# EAGLE design ECU (EAGLE 6.5.0)
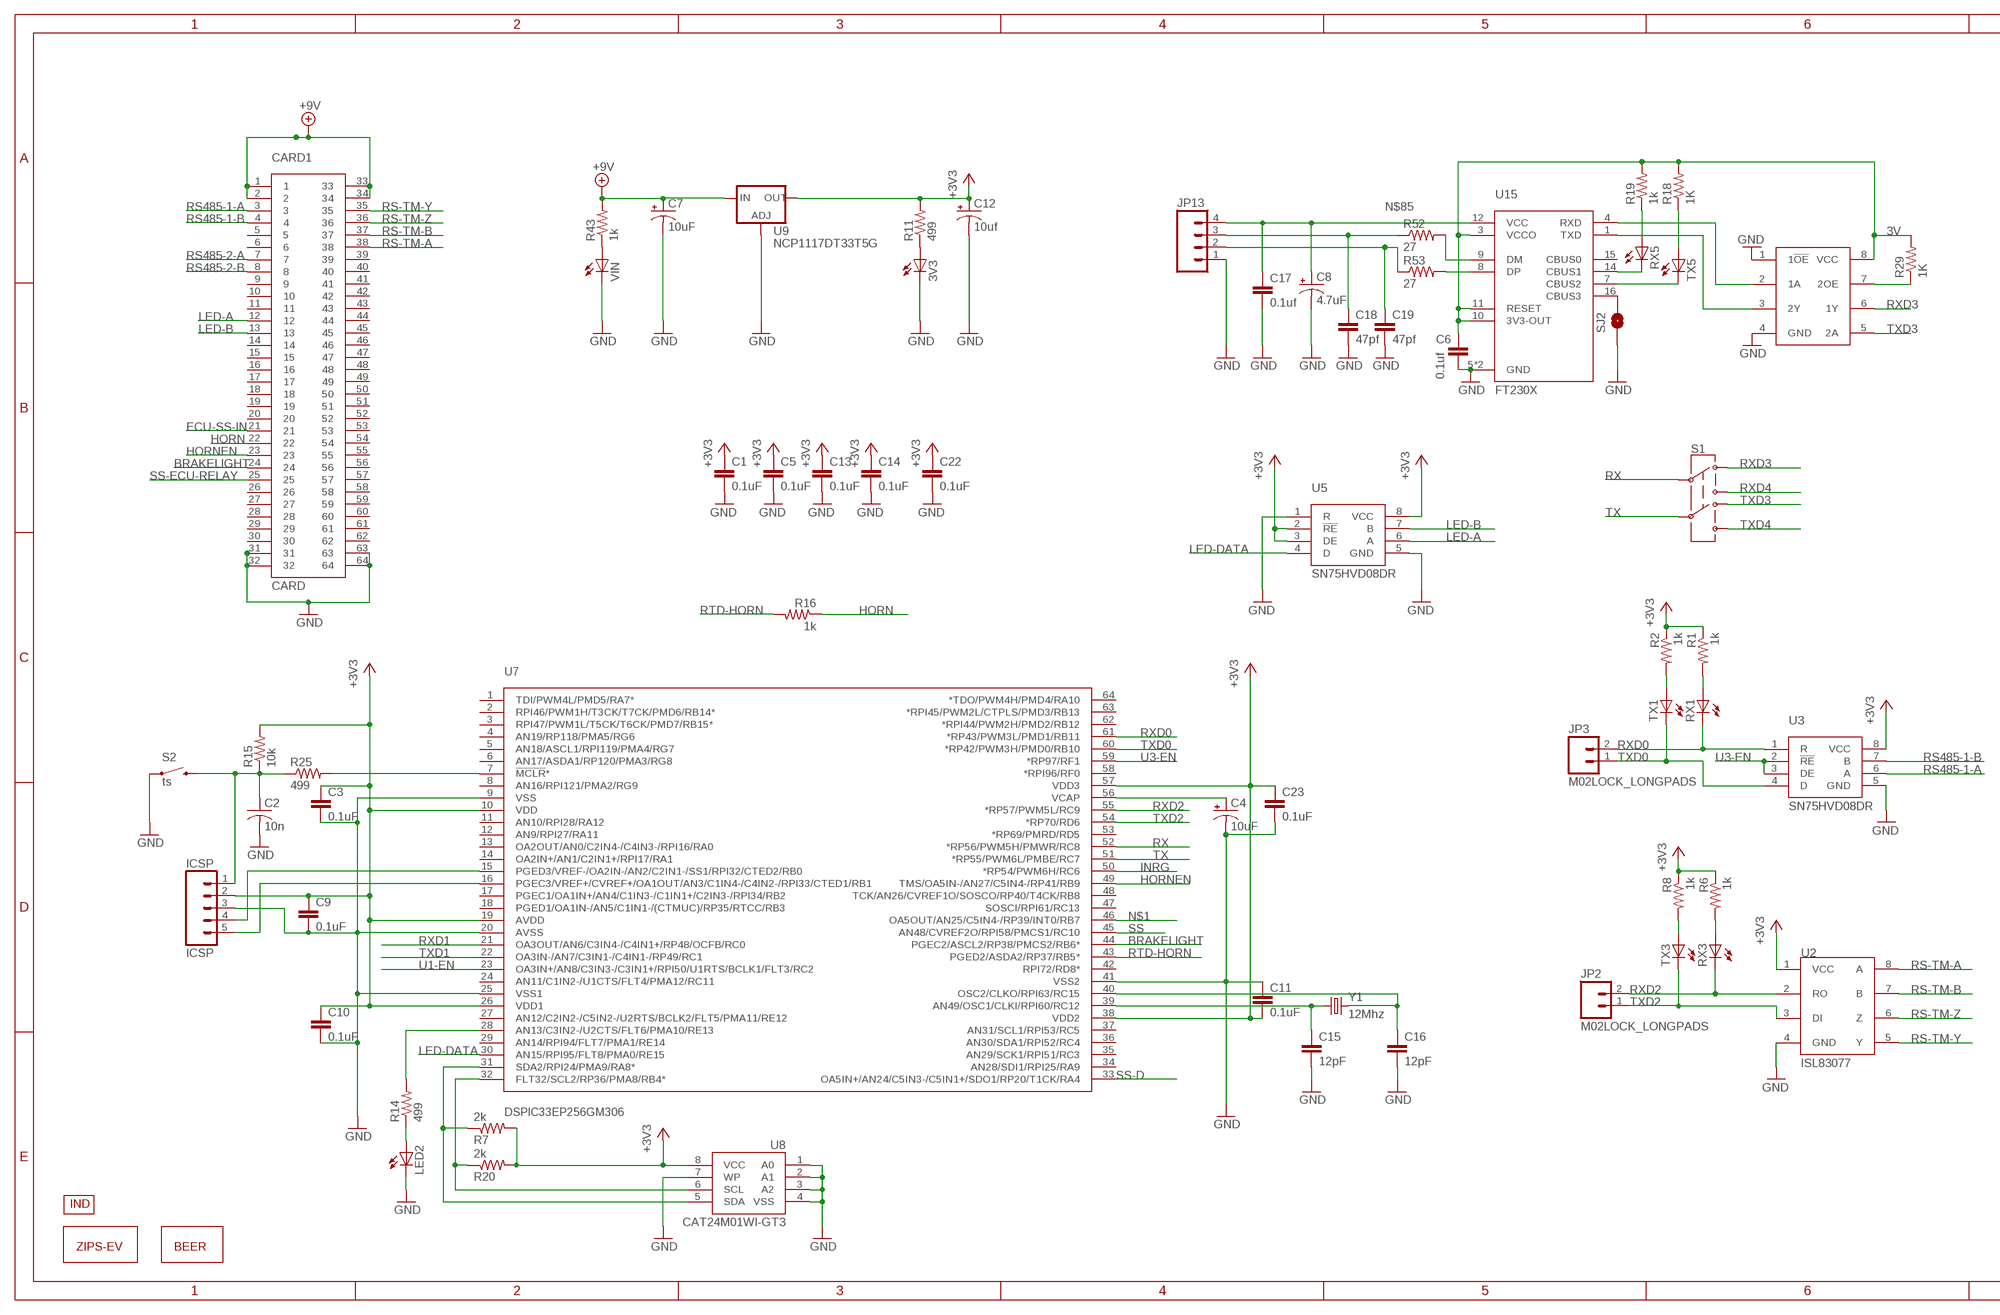
[diagram p0: schematic, sheet 1, part 1 of 2]
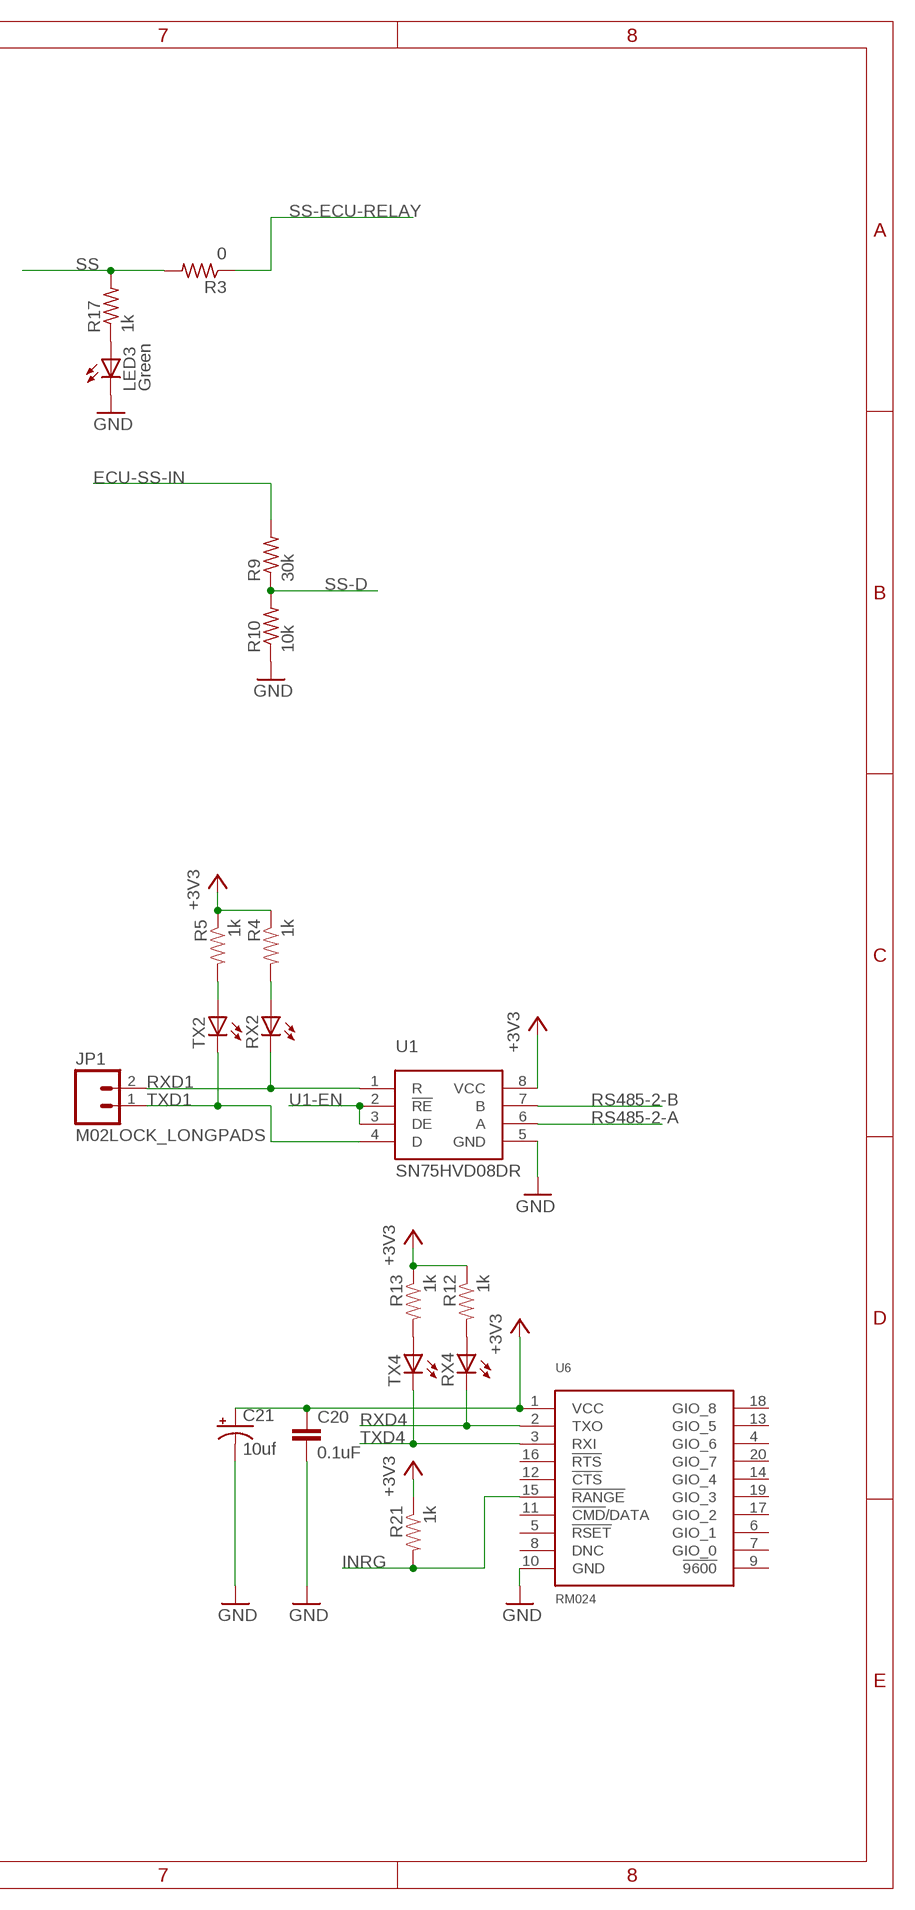
[diagram p1: schematic, sheet 1, part 2 of 2]

## Parts
3V3  LEDCHIP-LED0805  [CHIP-LED0805]
C1  0.1uF  CAP0805  [0805]
C2  10n  C-USC0805  [C0805]
C3  0.1uF  CAP0805  [0805]
C4  10uF  10UF-TANT  [EIA3216]
C5  0.1uF  CAP0805  [0805]
C6  0.1uf  CAP0805  [0805]
C7  10uF  CAP_POL7343  [EIA7343]
C8  4.7uF  CAP_POL1206  [EIA3216]
C9  0.1uF  CAP0805  [0805]
C10  0.1uF  CAP0805  [0805]
C11  0.1uF  CAP0805  [0805]
C12  10uf  CAP_POL3528  [EIA3528]
C13  0.1uF  CAP0805  [0805]
C14  0.1uF  CAP0805  [0805]
C15  12pF  CAP0805  [0805]
C16  12pF  CAP0805  [0805]
C17  0.1uf  CAP0805  [0805]
C18  47pf  CAP0805  [0805]
C19  47pf  CAP0805  [0805]
C20  0.1uF  CAP0805  [0805]
C21  10uf  CAP_POL3528  [EIA3528]
C22  0.1uF  CAP0805  [0805]
C23  0.1uF  CAP0805  [0805]
CARD1  CARD  [CARD-64]
ICSP  ICSP  M05LOCK_LONGPADS  [1X05_LOCK_LONGPADS]
JP1  M02LOCK_LONGPADS  [1X02_LOCK_LONGPADS]
JP2  M02LOCK_LONGPADS  [1X02_LOCK_LONGPADS]
JP3  M02LOCK_LONGPADS  [1X02_LOCK_LONGPADS]
JP13  M04POLAR_LOCK  [MOLEX-1X4_LOCK]
LED2  LEDCHIP-LED0805  [CHIP-LED0805]
LED3  Green  LEDCHIPLED_0805  [CHIPLED_0805]
R1  1k  RESISTOR0805-RES  [0805]
R2  1k  RESISTOR0805-RES  [0805]
R3  0  R-US_R0805  [R0805]
R4  1k  RESISTOR0805-RES  [0805]
R5  1k  RESISTOR0805-RES  [0805]
R6  1k  RESISTOR0805-RES  [0805]
R7  2k  RESISTOR0805-RES  [0805]
R8  1k  RESISTOR0805-RES  [0805]
R9  30k  R-US_R0805  [R0805]
R10  10k  R-US_R0805  [R0805]
R11  499  R-US_R0805  [R0805]
R12  1k  RESISTOR0805-RES  [0805]
R13  1k  RESISTOR0805-RES  [0805]
R14  499  RESISTOR0805-RES  [0805]
R15  10k  RESISTOR0805-RES  [0805]
R16  1k  RESISTOR0805-RES  [0805]
R17  1k  R-US_R0805  [R0805]
R18  1K  R-US_R0805  [R0805]
R19  1k  R-US_R0805  [R0805]
R20  2k  RESISTOR0805-RES  [0805]
R21  1k  RESISTOR0805-RES  [0805]
R25  499  RESISTOR0805-RES  [0805]
R29  1K  R-US_R0805  [R0805]
R43  1k  R-US_R0805  [R0805]
R52  27  RESISTOR0805-RES  [0805]
R53  27  RESISTOR0805-RES  [0805]
RX1  LEDCHIP-LED0805  [CHIP-LED0805]
RX2  LEDCHIP-LED0805  [CHIP-LED0805]
RX3  LEDCHIP-LED0805  [CHIP-LED0805]
RX4  LEDCHIP-LED0805  [CHIP-LED0805]
RX5  LEDCHIPLED_0805  [CHIPLED_0805]
S1  SWITCH-DPDTEG2211  [EG2211]
S2  ts  SWITCH-MOMENTARY-2SIDE_EZ  [TACTILE-PTH-SIDEEZ]
SJ2  JUMPER-PAD-2-NOYES_SILK  [PAD-JUMPER-2-NO_YES_SILK]
TX1  LEDCHIP-LED0805  [CHIP-LED0805]
TX2  LEDCHIP-LED0805  [CHIP-LED0805]
TX3  LEDCHIP-LED0805  [CHIP-LED0805]
TX4  LEDCHIP-LED0805  [CHIP-LED0805]
TX5  LEDCHIPLED_0805  [CHIPLED_0805]
U1  SN75HVD08DR  [SO-8]
U2  ISL83077  [SO08]
U3  SN75HVD08DR  [SO-8]
U4  SN74LVC2G241DCTR  [VFSOP-8]
U5  SN75HVD08DR  [SO-8]
U6  RM024  [RM024-TH]
U7  DSPIC33EP256GM306  [TQFP-64]
U8  CAT24M01WI-GT3  EEPROM-I2CSMD  [SO08]
U9  NCP1117DT33T5G  V_REG_317DPACK  [V-REG_DPACK]
U15  FT230X  [SSOP-16]
U$1  INDPK1  [PICKIT-PIN-1]
U$2  LOGOM  [L-M]
U$3  BEERM  [B-M]
VIN  LEDCHIP-LED0805  [CHIP-LED0805]
Y1  12Mhz  CRYSTAL5X3  [CRYSTAL-SMD-5X3]

## Nets
3V: C6.1 R18.2 R19.2 R29.2 U4.8(VCC) U15.3(VCCO) U15.10(3V3-OUT) U15.11(RESET)
+3V3: C1.1 C3.1 C5.1 C9.1 C10.1 C11.2 C12.A(+) C13.1 C14.1 C20.1 C21.A(+) C22.1 C23.1 ICSP.2 R1.1 R2.1 R4.1 R5.1 R6.1 R7.2 R8.1 R11.2 R12.1 R13.1 R15.2 R20.2 R21.1 U1.8(VCC) U2.1(VCC) U3.8(VCC) U5.2(!RE) U5.3(DE) U5.8(VCC) U6.1(VCC) U7.10(VDD) U7.19(AVDD) U7.26(VDD1) U7.38(VDD2) U7.57(VDD3) U8.8(VCC) U9.4(OUT)
+9V: C7.A(+) CARD1.1 CARD1.2 CARD1.33 CARD1.34 R43.2 U9.3(IN)
BRAKELIGHT: CARD1.24 U7.44(PGEC2/ASCL2/RP38/PMCS2/RB6*)
ECU-SS-IN: CARD1.21 R9.2
GND: 3V3.C C1.2 C2.2 C3.2 C4.C(-) C5.2 C6.2 C7.C(-) C8.C(-) C9.2 C10.2 C11.1 C12.C(-) C13.2 C14.2 C15.2 C16.2 C17.2 C18.2 C19.2 C20.2 C21.C(-) C22.2 C23.2 CARD1.31 CARD1.32 CARD1.63 CARD1.64 ICSP.3 JP13.1 LED2.C LED3.C R10.1 S2.1 SJ2.1 U1.5(GND) U2.4(GND) U3.5(GND) U4.1(1!OE) U4.4(GND) U5.1(R) U5.5(GND) U6.10(GND) U7.9(VSS) U7.20(AVSS) U7.25(VSS1) U7.41(VSS2) U8.1(A0) U8.2(A1) U8.3(A2) U8.4(VSS) U8.7(WP) U9.1(ADJ) U15.5(GND) U15.13(GND) VIN.C
HORN: CARD1.22 R16.1
HORNEN: CARD1.23 U7.49(TMS/OA5IN-/AN27/C5IN4-/RP41/RB9)
INRG: R21.2 U6.15(!RANGE) U7.50(*RP54/PWM6H/RC6)
LED-A: CARD1.12 U5.6(A)
LED-B: CARD1.13 U5.7(B)
LED-DATA: U5.4(D) U7.30(AN15/RPI95/FLT8/PMA0/RE15)
N$1: U7.46(OA5OUT/AN25/C5IN4-/RP39/INT0/RB7)
N$2: R14.2 U7.28(AN13/C3IN2-/U2CTS/FLT6/PMA10/RE13)
N$3: 3V3.A R11.1
N$4: R18.1 TX5.A
N$5: R4.2 RX2.A
N$6: R5.2 TX2.A
N$7: R1.2 RX1.A
N$8: R2.2 TX1.A
N$9: R6.2 RX3.A
N$10: R8.2 TX3.A
N$11: R12.2 RX4.A
N$12: R13.2 TX4.A
N$13: C16.1 U7.40(OSC2/CLKO/RPI63/RC15) Y1.3
N$14: C15.1 U7.39(AN49/OSC1/CLKI/RPI60/RC12) Y1.1
N$15: LED2.A R14.1
N$16: R7.1 U7.31(SDA2/RPI24/PMA9/RA8*) U8.5(SDA)
N$18: R19.1 RX5.A
N$19: TX5.C U15.7(CBUS2)
N$20: RX5.C U15.14(CBUS1)
N$21: U4.2(1A) U15.4(RXD)
N$27: U4.3(2Y) U15.1(TXD)
N$28: R52.2 U15.9(DM)
N$32: R20.1 U7.32(FLT32/SCL2/RP36/PMA8/RB4*) U8.6(SCL)
N$33: R43.1 VIN.A
N$49: LED3.A R17.1
N$54: R53.2 U15.8(DP)
N$55: C18.1 JP13.3 R52.1
N$61: C19.1 JP13.2 R53.1
N$62: SJ2.2 U15.16(CBUS3)
N$69: R29.1 U4.7(2OE)
N$85: C8.A(+) C17.1 JP13.4 U15.12(VCC)
N$86: C2.1 ICSP.1 R15.1 R25.1 S2.2
N$87: R25.2 U7.7(!MCLR!*)
N$88: C4.A(+) U7.56(VCAP)
N$90: ICSP.4 U7.15(PGED3/VREF-/OA2IN-/AN2/C2IN1-/SS1/RPI32/CTED2/RB0)
N$91: ICSP.5 U7.16(PGEC3/VREF+/CVREF+/OA1OUT/AN3/C1IN4-/C4IN2-/RPI33/CTED1/RB1)
RS485-1-A: CARD1.3 U3.6(A)
RS485-1-B: CARD1.4 U3.7(B)
RS485-2-A: CARD1.7 U1.6(A)
RS485-2-B: CARD1.8 U1.7(B)
RS-TM-A: CARD1.38 U2.8(A)
RS-TM-B: CARD1.37 U2.7(B)
RS-TM-Y: CARD1.35 U2.5(Y)
RS-TM-Z: CARD1.36 U2.6(Z)
RTD-HORN: R16.2 U7.43(PGED2/ASDA2/RP37/RB5*)
RX: S1.P1 U7.52(*RP56/PWM5H/PMWR/RC8)
RXD0: JP3.2 RX1.C U3.1(R) U7.61(*RP43/PWM3L/PMD1/RB11)
RXD1: JP1.2 RX2.C U1.1(R) U7.21(OA3OUT/AN6/C3IN4-/C4IN1+/RP48/OCFB/RC0)
RXD2: JP2.2 RX3.C U2.2(RO) U7.55(*RP57/PWM5L/RC9)
RXD3: S1.P1-TA U4.6(1Y)
RXD4: RX4.C S1.P1-TB U6.2(TXO)
SS: R3.2 R17.2 U7.45(AN48/CVREF2O/RPI58/PMCS1/RC10)
SS-D: R9.1 R10.2 U7.33(OA5IN+/AN24/C5IN3-/C5IN1+/SDO1/RP20/T1CK/RA4)
SS-ECU-RELAY: CARD1.25 R3.1
TX: S1.P2 U7.51(*RP55/PWM6L/PMBE/RC7)
TXD0: JP3.1 TX1.C U3.4(D) U7.60(*RP42/PWM3H/PMD0/RB10)
TXD1: JP1.1 TX2.C U1.4(D) U7.22(OA3IN-/AN7/C3IN1-/C4IN1-/RP49/RC1)
TXD2: JP2.1 TX3.C U2.3(DI) U7.54(*RP70/RD6)
TXD3: S1.P2-TA U4.5(2A)
TXD4: S1.P2-TB TX4.C U6.3(RXI)
U1-EN: U1.2(!RE) U1.3(DE) U7.23(OA3IN+/AN8/C3IN3-/C3IN1+/RPI50/U1RTS/BCLK1/FLT3/RC2)
U3-EN: U3.2(!RE) U3.3(DE) U7.59(*RP97/RF1)
Unconnected: CARD1.5 CARD1.6 CARD1.9 CARD1.10 CARD1.11 CARD1.14 CARD1.15 CARD1.16 CARD1.17 CARD1.18 CARD1.19 CARD1.20 CARD1.26 CARD1.27 CARD1.28 CARD1.29 CARD1.30 CARD1.39 CARD1.40 CARD1.41 CARD1.42 CARD1.43 CARD1.44 CARD1.45 CARD1.46 CARD1.47 CARD1.48 CARD1.49 CARD1.50 CARD1.51 CARD1.52 CARD1.53 CARD1.54 CARD1.55 CARD1.56 CARD1.57 CARD1.58 CARD1.59 CARD1.60 CARD1.61 CARD1.62 U6.4(GIO_6) U6.5(!RSET) U6.6(GIO_1) U6.7(GIO_0) U6.8(DNC) U6.9(!9600) U6.11(!CMD!/DATA) U6.12(!CTS) U6.13(GIO_5) U6.14(GIO_4) U6.16(!RTS) U6.17(GIO_2) U6.18(GIO_8) U6.19(GIO_3) U6.20(GIO_7) U7.1(TDI/PWM4L/PMD5/RA7*) U7.2(RPI46/PWM1H/T3CK/T7CK/PMD6/RB14*) U7.3(RPI47/PWM1L/T5CK/T6CK/PMD7/RB15*) U7.4(AN19/RP118/PMA5/RG6) U7.5(AN18/ASCL1/RPI119/PMA4/RG7) U7.6(AN17/ASDA1/RP120/PMA3/RG8) U7.8(AN16/RPI121/PMA2/RG9) U7.11(AN10/RPI28/RA12) U7.12(AN9/RPI27/RA11) U7.13(OA2OUT/AN0/C2IN4-/C4IN3-/RPI16/RA0) U7.14(OA2IN+/AN1/C2IN1+/RPI17/RA1) U7.17(PGEC1/OA1IN+/AN4/C1IN3-/C1IN1+/C2IN3-/RPI34/RB2) U7.18(PGED1/OA1IN-/AN5/C1IN1-/(CTMUC)/RP35/RTCC/RB3) U7.24(AN11/C1IN2-/U1CTS/FLT4/PMA12/RC11) U7.27(AN12/C2IN2-/C5IN2-/U2RTS/BCLK2/FLT5/PMA11/RE12) U7.29(AN14/RPI94/FLT7/PMA1/RE14) U7.34(AN28/SDI1/RPI25/RA9) U7.35(AN29/SCK1/RPI51/RC3) U7.36(AN30/SDA1/RPI52/RC4) U7.37(AN31/SCL1/RPI53/RC5) U7.42(RPI72/RD8*) U7.47(SOSCI/RPI61/RC13) U7.48(TCK/AN26/CVREF1O/SOSCO/RP40/T4CK/RB8) U7.53(*RP69/PMRD/RD5) U7.58(*RPI96/RF0) U7.62(*RPI44/PWM2H/PMD2/RB12) U7.63(*RPI45/PWM2L/CTPLS/PMD3/RB13) U7.64(*TDO/PWM4H/PMD4/RA10) U15.15(CBUS0)

## Library data of the parts
3V3 LED2 LED3 RX1-RX5 TX1-TX5 VIN = adafruit:LED: LED OSRAM: - CHIPLED LG R971, LG N971, LY N971, LG Q971, LY Q971, LO R971, LY R971 LH N974, LH R974 LS Q976, LO Q976, LY Q976 LO Q996 - Hyper CHIPLED LW Q18S LB Q993, LB Q99A, LB R99A - SideLED LS A670, LO A670, LY A670, LG A670, LP A670 LB A673, LV A673, LT A673, LW A673 LH A674 LY A675 LS A676, LA A676, LO A676, LY A676, LW A676 LS A679, LY A679, LG A679 - Hyper Micro SIDELED® LS Y876, LA Y876, LO Y876, LY Y876 LT Y87S - SmartLED LW L88C, LW L88S LB L89C, LB L89S, LG L890 LS L89K, LO L89K, LY L89K LS L896, LA L896, LO L896, LY L896 - TOPLED LS T670, LO T670, LY T670, LG T670, LP T670 LSG T670, LSP T670, LSY T670, LOP T670, LYG T670 LG T671, LOG T671, LSG T671 LB T673, LV T673, LT T673, LW T673 LH T674 LS T676, LA T676, LO T676, LY T676, LB T676, LH T676, LSB T676, LW T676 LB T67C, LV T67C, LT T67C, LS T67K, LO T67K, LY T67K, LW E67C LS E67B, LA E67B, LO E67B, LY E67B, LB E67C, LV E67C, LT E67C LW T67C LS T679, LY T679, LG T679 LS T770, LO T770, LY T770, LG T770, LP T770 LB T773, LV T773, LT T773, LW T773 LH T774 LS E675, LA E675, LY E675, LS T675 LS T776, LA T776, LO T776, LY T776, LB T776 LHGB T686 LT T68C, LB T68C - Hyper Mini TOPLED® LB M676 - Mini TOPLED Santana® LG M470 LS M47K, LO M47K, LY M47K Source: http://www.osram.convergy.de/
C1 C3 C5 C9-C11 C13-C16 C20 C22 C23 = SparkFun-Capacitors:CAP: Capacitor Standard 0603 ceramic capacitor, and 0.1" leaded capacitor.
C2 = adafruit:C-US: CAPACITOR, American symbol
C4 = SparkFun-Capacitors:10UF-TANT: 10uF Tantalum SMT CAP-00811- 16V 10% (EIA-3216); PROD_ID: CAP-00811
C6 C17-C19 = SparkFun:CAP: Capacitor Standard 0603 ceramic capacitor, and 0.1" leaded capacitor.
C7 C12 C21 = SparkFun-Capacitors:CAP_POL: Capacitor Polarized These are standard SMD and PTH capacitors. Normally 10uF, 47uF, and 100uF in electrolytic and tantalum varieties. Always verify the external diameter of the through hole cap, it varies with capacity, voltage, and manufacturer. The EIA devices should be standard.
C8 = SparkFun:CAP_POL: Capacitor Polarized These are standard SMD and PTH capacitors. Normally 10uF, 47uF, and 100uF in electrolytic and tantalum varieties. Always verify the external diameter of the through hole cap, it varies with capacity, voltage, and manufacturer. The EIA devices should be standard.
CARD1 = FSAE Eletric:CARD
ICSP = SparkFun-Connectors:M05: Header 5 Standard 5-pin 0.1" header. Use with straight break away headers (SKU : PRT-00116), right angle break away headers (PRT-00553), swiss pins (PRT-00743), machine pins (PRT-00117), and female headers (PRT-00115). Molex polarized connector foot print use with SKU : PRT-08230 with associated crimp pins and housings.
JP1-JP3 = SparkFun-Connectors:M02: Standard 2-pin 0.1" header. Use with - straight break away headers ( PRT-00116) - right angle break away headers (PRT-00553) - swiss pins (PRT-00743) - machine pins (PRT-00117) - female headers (PRT-00115) Molex polarized connector foot print use with: PRT-08233 with associated crimp pins and housings. 2.54_SCREWTERM for use with PRT-10571. 3.5mm Screw Terminal footprints for PRT-08084 5mm Screw Terminal footprints for use with PRT-08433
JP13 = SparkFun-Connectors:M04: Header 4 Standard 4-pin 0.1" header. Use with straight break away headers (SKU : PRT-00116), right angle break away headers (PRT-00553), swiss pins (PRT-00743), machine pins (PRT-00117), and female headers (PRT-00115). Molex polarized connector foot print use with SKU : PRT-08231 with associated crimp pins and housings. 1MM SMD Version SKU: PRT-10208
R1 R2 R4-R8 R12-R16 R20 R21 R52 R53 = SparkFun-Passives:RESISTOR: Resistor Basic schematic elements and footprints for 0603, 1206, and PTH resistors.
R3 R9-R11 R17-R19 R29 R43 = adafruit:R-US_: RESISTOR, American symbol
R25 = SparkFun-Resistors:RESISTOR: Resistor Basic schematic elements and footprints for 0603, 1206, and PTH resistors.
S1 = SparkFun-Electromechanical:SWITCH-DPDT: DPDT Version of the COM-00597
S2 = SparkFun-Electromechanical:SWITCH-MOMENTARY-2: Various NO switches- pushbuttons, reed, etc
SJ2 = SparkFun-Passives:JUMPER-PAD-2-NO
U1 U3 U5 = FSAE Eletric:SN75HVD08DR
U2 = NASA_LIB:ISL83077
U4 = Cleaverbrooks:SN74LVC2G241DCTR
U6 = FSAE Eletric:RM024
U7 = FSAE Eletric:DSPIC33EP256GM306
U8 = SparkFun-DigitalIC:EEPROM-I2C: I2C EEPROM chips, 24LC256 (and others)
U9 = SparkFun-PowerIC:V_REG_317: Voltage Regulator Standard LM317 adjustable voltage regulator. AOI (Adjust Output Input). Google 'LM317 Calculator' for easy to use app to get the two resistor values needed. 240/720 for 5V output. 240/390 for 3.3V output. Spark Fun Electronics SKU : COM-00527
U15 = FSAE Eletric:FT230X
U$1 = FSAE Eletric:IND
U$2 = Pic:LOGO
U$3 = Pic:BEER
Y1 = SparkFun-FreqCtrl:CRYSTAL: Various standard crystals. Proven footprints. Spark Fun Electronics SKU : COM-00534

## Board
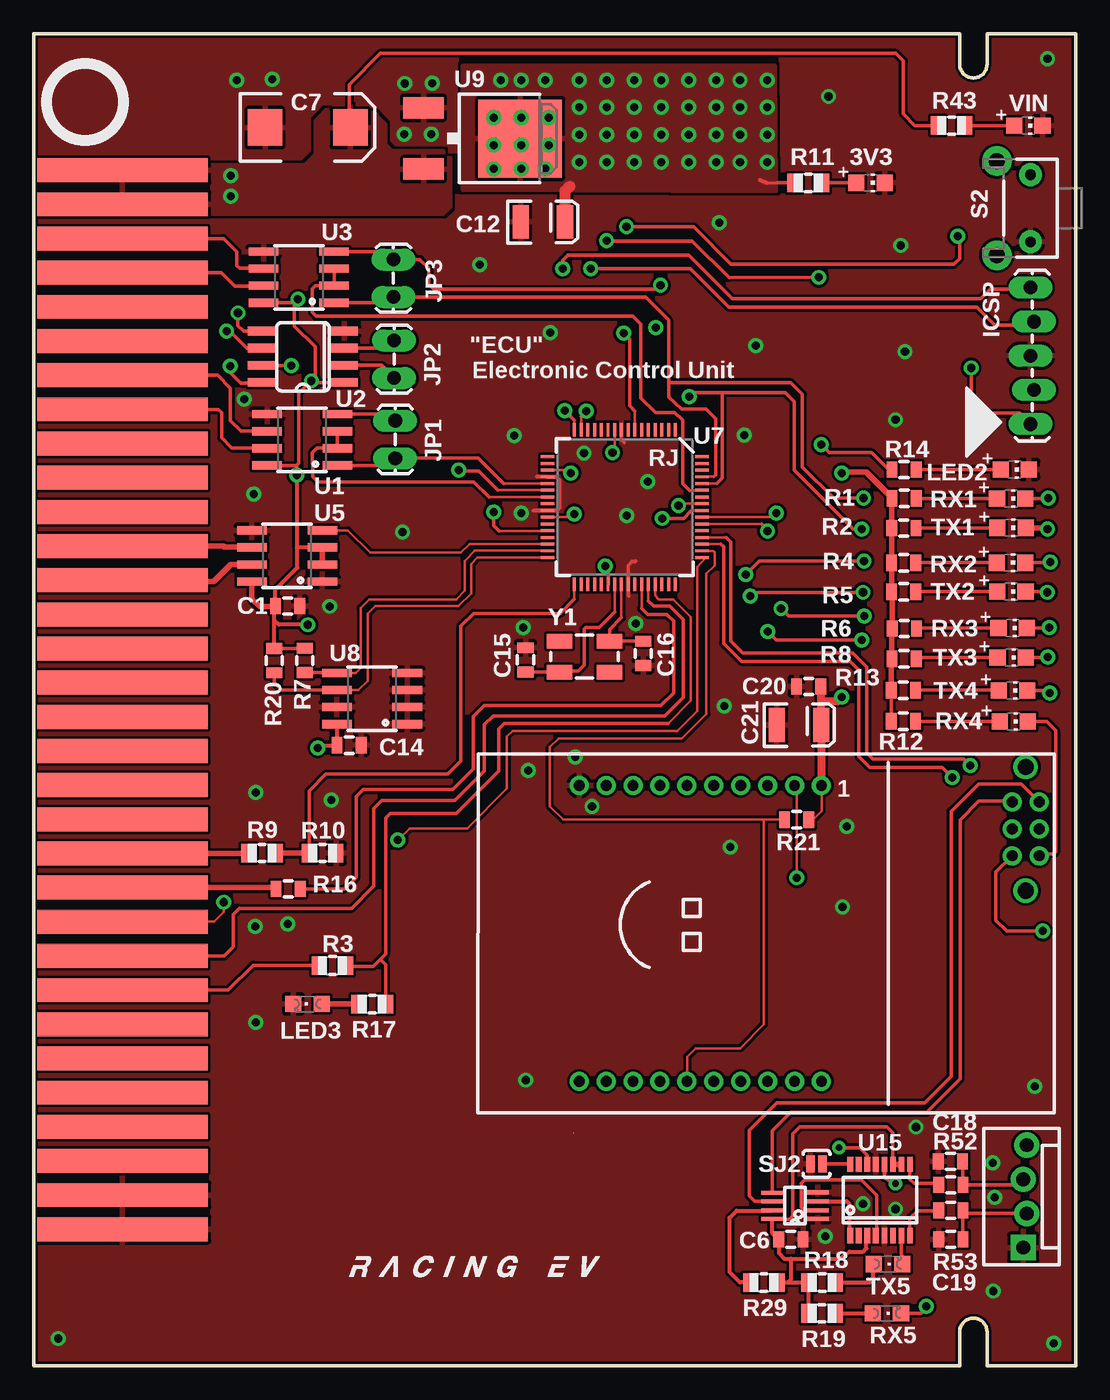
[diagram p2: board, top side]
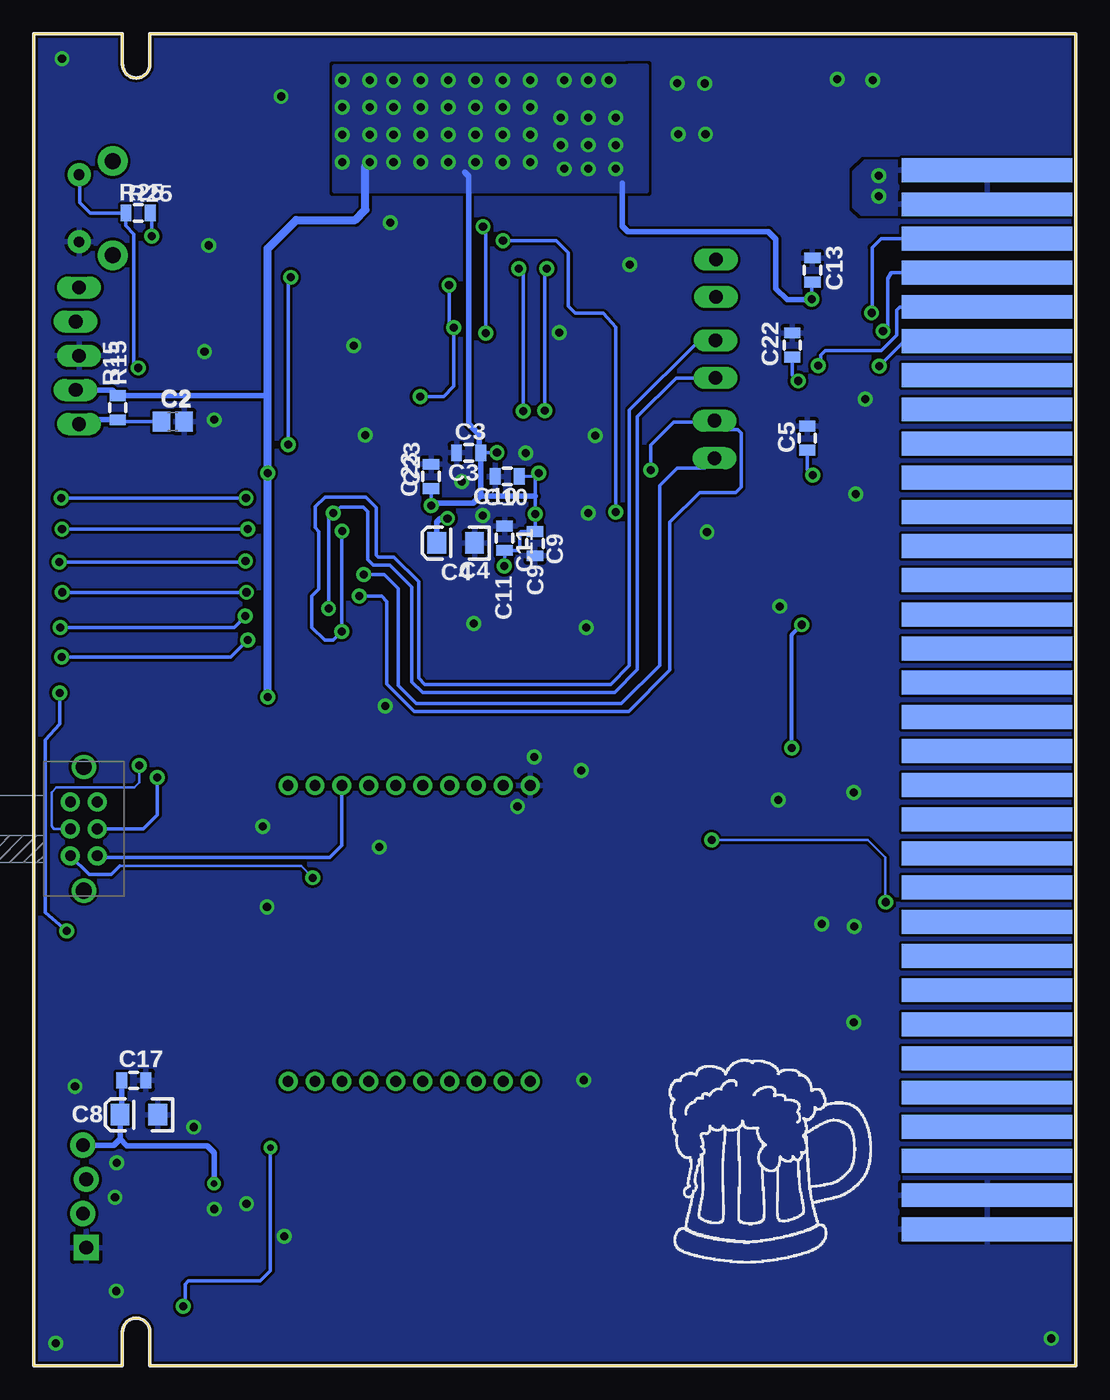
[diagram p3: board, bottom side, seen from below]